# EasyEDA Pro project SuperCapTestBoard - copy - 2 25.eprj (continued)
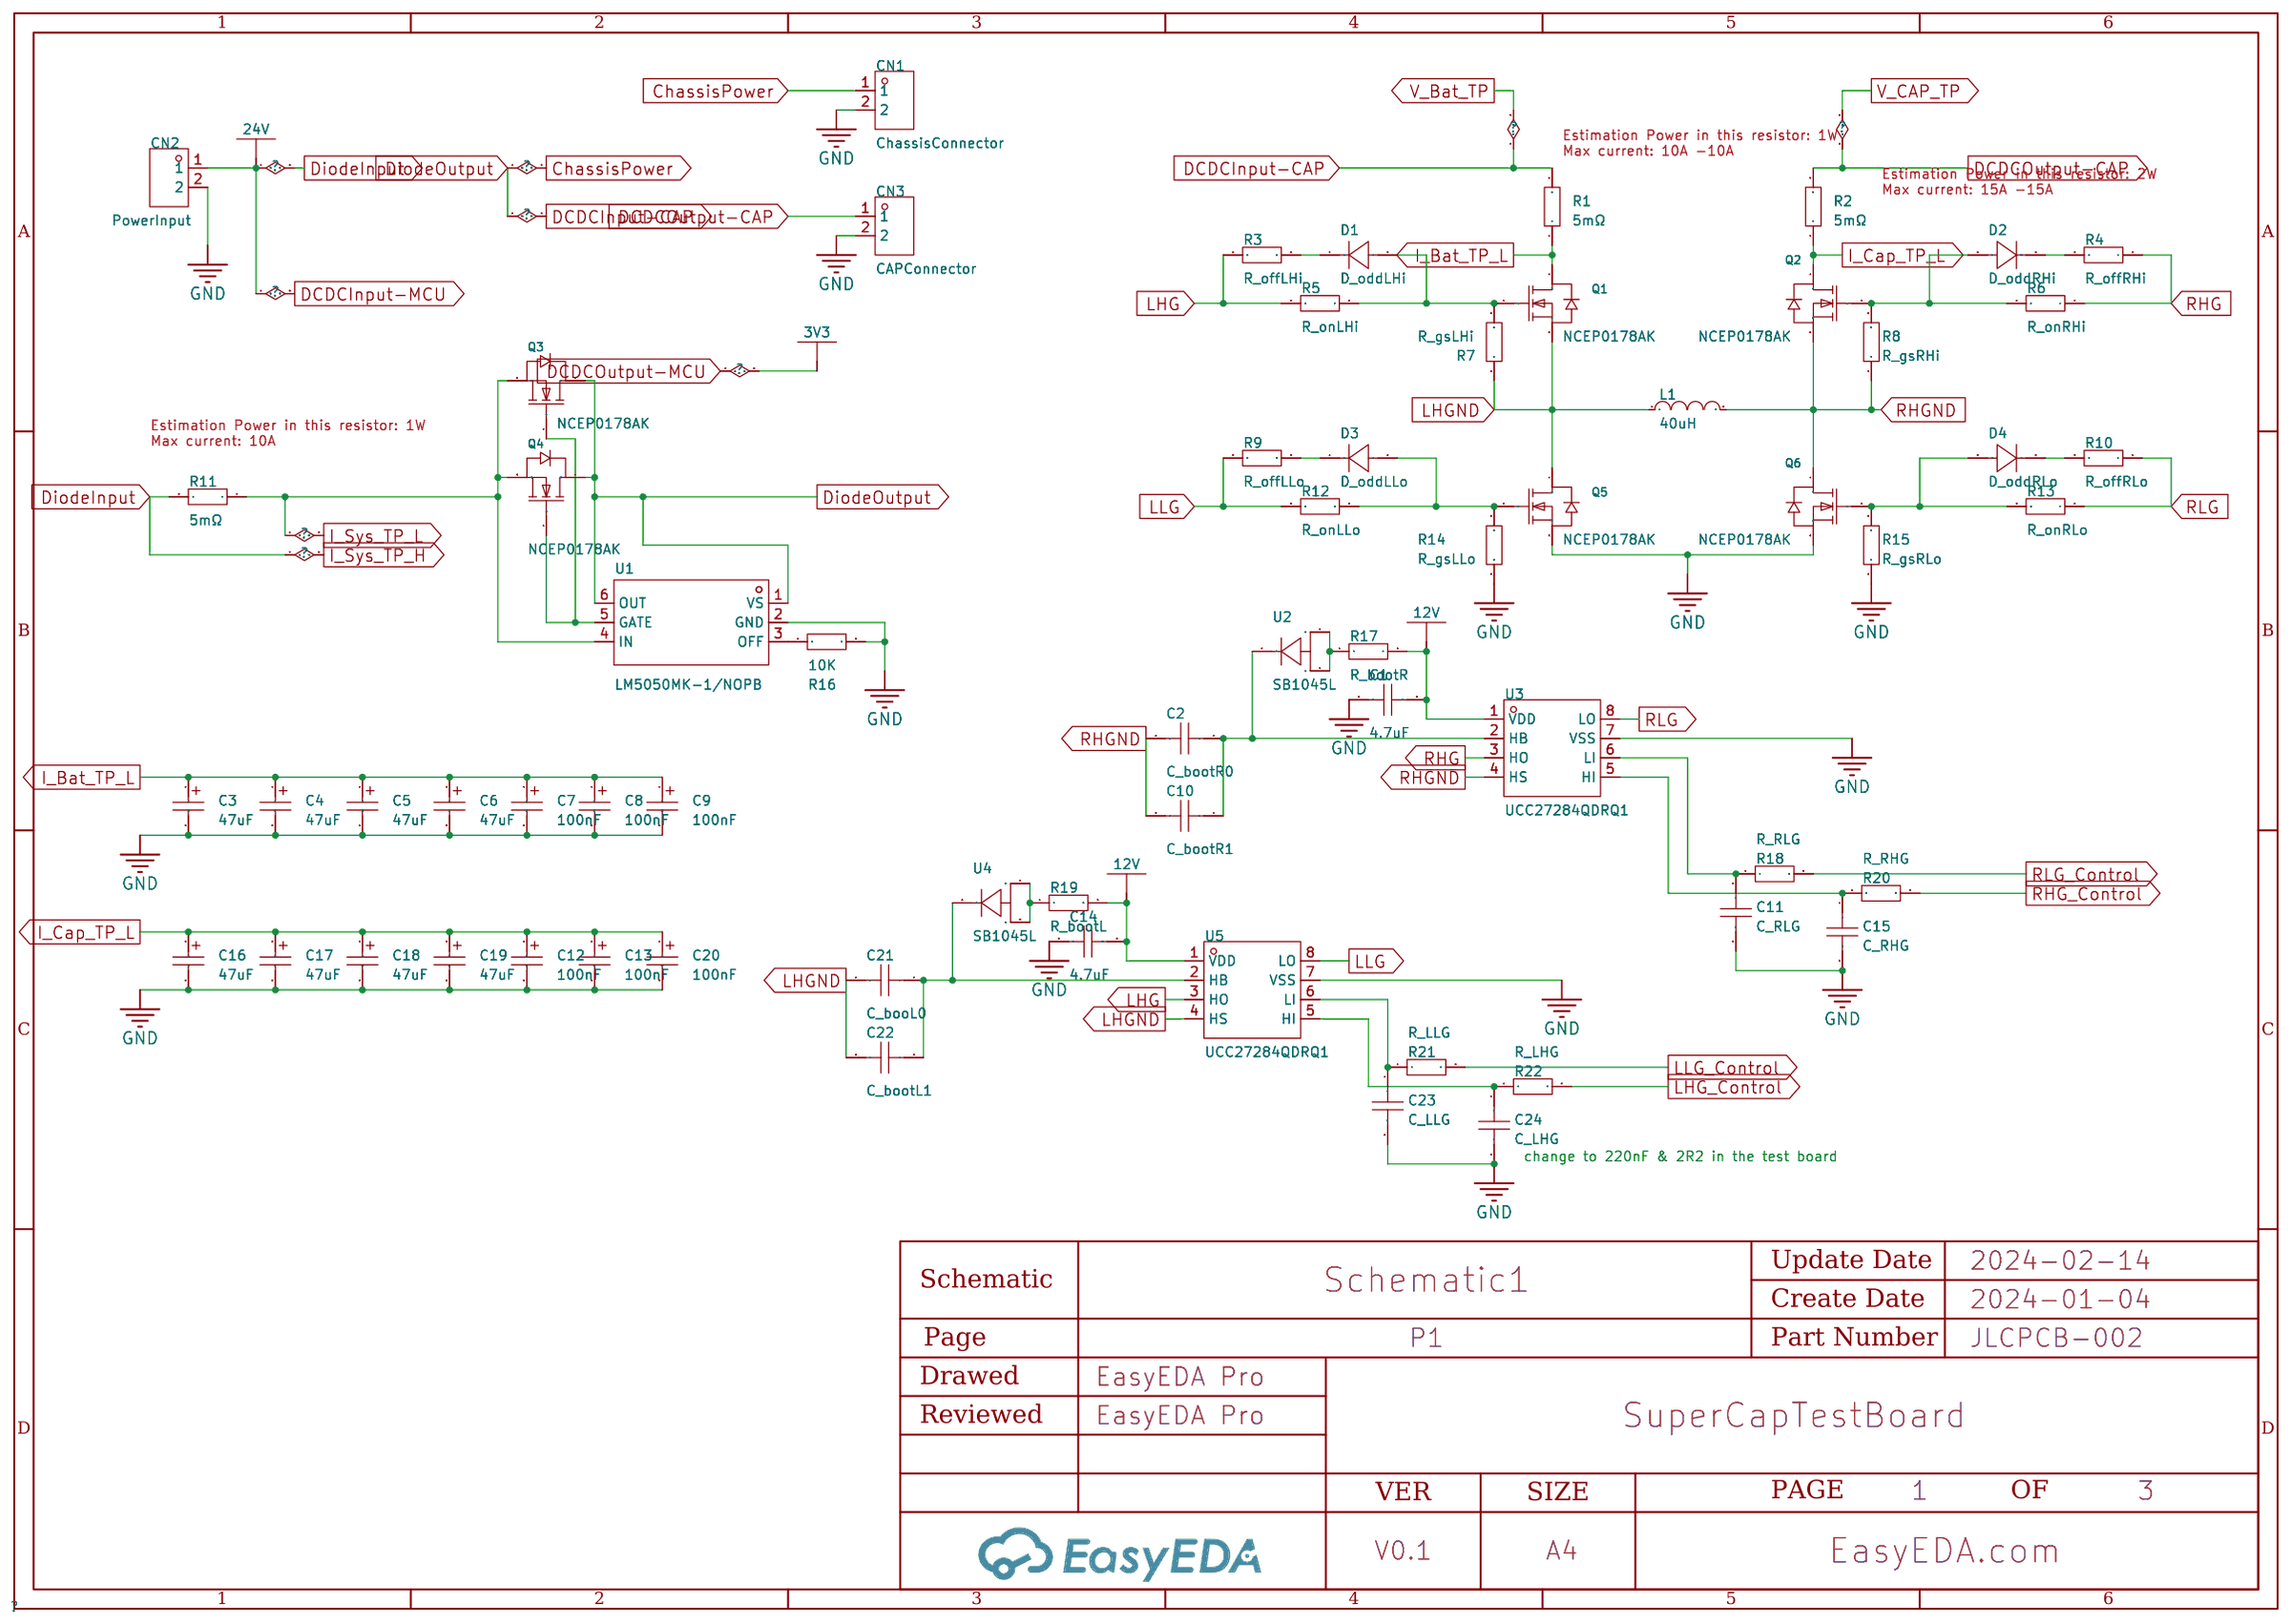
[diagram p0: P1]
## Placement (name value [footprint] x y rotation side) (continued)
L3  10uH  [L0805]  14.09 75.24 0 top
Q1  NCEP0178AK  [TO-252-2_L6.5-W6.1-P4.58-LS10.0-TL]  41.66 25.07 90 top
Q2  NCEP0178AK  [TO-252-2_L6.5-W6.1-P4.58-LS10.0-TL]  73.22 39.45 0 top
Q3  NCEP0178AK  [TO-252-2_L6.5-W6.1-P4.58-LS10.0-TL]  41.78 40.95 180 top
Q4  NCEP0178AK  [TO-252-2_L6.5-W6.1-P4.58-LS10.0-TL]  28.19 40.95 180 top
Q5  NCEP0178AK  [TO-252-2_L6.5-W6.1-P4.58-LS10.0-TL]  37.53 11.07 90 top
Q6  NCEP0178AK  [TO-252-2_L6.5-W6.1-P4.58-LS10.0-TL]  60.01 39.58 0 top
R1  5mΩ  [R2512]  50.29 35.36 90 top
R2  5mΩ  [R2512]  76.71 48.31 90 top
R3  2.2  [R0603]  20.19 17.32 0 top
R4  2.2  [R0603]  73.28 64.95 180 top
R5  2.2  [R0603]  23.24 13.89 0 top
R6  2.2  [R0603]  71.25 62.66 180 top
R7  10K  [R0603]  32 18.59 270 top
R8  10K  [R0603]  66.04 62.66 0 top
R9  2.2  [R0603]  20.19 10.97 0 top
R10  2.2  [R0603]  74.29 59.61 180 top
R11  5mΩ  [R2512]  36.19 58.85 90 top
R12  2.2  [R0603]  23.24 7.8 0 top
R13  2.2  [R0603]  72.01 56.82 180 top
R14  10K  [R0603]  32 6.78 90 top
R15  10K  [R0603]  61.85 44.88 270 top
R16  10K  [R0603]  18.29 38.28 180 top
R17  2.2  [R0805_NEW]  75.95 67.74 0 top
R18  10  [R0603]  85.98 62.66 0 top
R19  2.2  [R0805_NEW]  12.7 18.97 180 top
R20  10  [R0603]  82.68 58.47 270 top
R21  10  [R0603]  16.42 9.38 270 top
R22  10  [R0603]  16.36 6.11 270 top
R23  510K  [R0603]  3.3 50.47 0 top
R24  900k  [R0603]  17.14 48.31 0 top
R25  510K  [R0603]  7.11 49.71 180 top
R26  100k  [R0603]  13.84 48.31 0 top
R27  10k  [R0603]  63.63 76.38 90 top
R28  10k  [R0603]  63.88 72.7 90 top
R29  20k  [R0603]  47.82 46.34 270 top
R30  20k  [R0603]  89.64 49.3 180 top
R31  2k  [R0603]  47.82 49.52 270 top
R32  2k  [R0603]  92.94 49.3 180 top
U1  LM5050MK-1/NOPB  [TSOT-23-6_L2.9-W1.6-P0.95-LS2.8-BR]  18.16 41.96 270 top
U2  SB1045L  [TO-277_3P-L5.4-W4.0-LS6.5-TR]  76.71 72.19 0 top
U3  UCC27284QDRQ1  [SOIC-8_L4.9-W3.9-P1.27-LS6.0-BL]  79.88 63.3 270 top
U4  SB1045L  [TO-277_3P-L5.4-W4.0-LS6.5-TR]  15.73 22.42 180 top
U5  UCC27284QDRQ1  [SOIC-8_L4.9-W3.9-P1.27-LS6.0-BL]  14.48 14.4 270 top
U6  SY8501FCC  [SO-8_L4.9-W3.9-P1.27-LS6.0-BL-EP]  12.7 52.76 270 top
U7  LM1117DTX-3.3/NOPB  [TO-252-2_L6.6-W6.1-P4.57-LS9.9-BR-CW]  6.35 69.27 270 top
U8  INA181A1IDBVT  [SOT-23-6_L2.9-W1.6-P0.95-LS2.8-BL]  48.01 66.09 90 top
U9  INA181A1IDBVT  [SOT-23-6_L2.9-W1.6-P0.95-LS2.8-BL]  82.55 46.53 90 top
U10  INA181A1IDBVT  [SOT-23-6_L2.9-W1.6-P0.95-LS2.8-BL]  55.5 45.39 90 top
U11  TLV521DCKR  [SC-70-5_L2.1-W1.3-P0.65-LS2.1-BR]  61.34 74.6 270 top

## Footprints (pads in the part's own frame, mm; a bottom-side part is the same pattern mirrored in y, then rotated)
C0603
  rect 0.8x0.9 smd: 1(-0.7,0) 2(0.7,0)
CAP-SMD_BD6.3-L6.6-W6.6-LS7.2-FD-1
  rect 3.5x1.2 smd: 1(-2.67,0) 2(2.67,0)
CAP-SMD_L3.2-W1.6-RD-C7171
  rect 1.758x1.296 smd: 1(-1.687,0) 2(1.687,0)
CONN-TH_XT30U-M
  round 3.8 hole 2.54: 1(-2.5,0) 2(2.5,0)
DO-214AC_L4.3-W2.4-LS4.7-RD
  rect 2x2 smd: 1(-2.15,0) 2(2.15,0)
do-214ac_l4.3-w2.7-ls5.2-rd
  rect 2x2 smd: 1(-2.3,0) 2(2.3,0)
HDR-TH_2P-P2.54-V-F
  rect 1.7x1.7 hole 1: 1(-1.27,0)
  round 1.7 hole 1: 2(1.27,0)
ind-smd_l7.0-w6.6_cmkd-0630a
  rect 2.6x3.5 smd: 1(-3.035,0) 2(3.035,0)
Inductor 080125
  round 2.5 hole 1.4: 1(0,-4) 2(0,-14)
L0805
  rect 1.133x1.377 smd: 1(-0.966,0) 2(0.966,0)
R0603
  rect 0.806x0.864 smd: 1(-0.753,0) 2(0.753,0)
R0805_NEW
  rect 1.133x1.377 smd: 1(-0.966,0) 2(0.966,0)
R2512
  rect 1.282x3.456 smd: 1(-3.067,0) 2(3.067,0)
SC-70-5_L2.1-W1.3-P0.65-LS2.1-BR
  rect 0.9x0.4 smd: 1(1.1,-0.65) 2(1.1,0) 3(1.1,0.65) 4(-1.1,0.65) 5(-1.1,-0.65)
SO-8_L4.9-W3.9-P1.27-LS6.0-BL-EP
  oval 0.6x1.6 smd: 1(-1.905,-3) 2(-0.635,-3) 3(0.635,-3) 4(1.905,-3) 5(1.905,3) 6(0.635,3) 7(-0.635,3) 8(-1.905,3)
  rect 3.2x2.5 smd: 9(0,0)
SOIC-8_L4.9-W3.9-P1.27-LS6.0-BL
  oval 0.588x2.045 smd: 1(-1.905,-2.772) 2(-0.635,-2.772) 3(0.635,-2.772) 4(1.905,-2.772) 5(1.905,2.772) 6(0.635,2.772) 7(-0.635,2.772) 8(-1.905,2.772)
SOT-23-6_L2.9-W1.6-P0.95-LS2.8-BL
  rect 0.532x1.072 smd: 1(-0.95,-1.149) 2(0,-1.149) 3(0.95,-1.149) 4(0.95,1.149) 5(0,1.149) 6(-0.95,1.149)
TO-252-2_L6.5-W6.1-P4.58-LS10.0-TL
  rect 2.8x1.35 smd: 1(-3.475,2.29)
  rect 2.8x1.5 smd: 3(-3.475,-2.29)
  rect 6.5x6 smd: 4(3.475,-0.017)
TO-252-2_L6.6-W6.1-P4.57-LS9.9-BR-CW
  rect 3x1.6 smd: 1(3.424,-2.29) 3(3.424,2.29)
  rect 6.2x5.8 smd: 2(-3.424,0)
TO-277_3P-L5.4-W4.0-LS6.5-TR
  rect 1.29x1.423 smd: 1(2.054,0.92) 3(2.054,-0.92)
  rect 5.2x3.8 smd: 2(-2.054,0)
TSOT-23-6_L2.9-W1.6-P0.95-LS2.8-BR
  rect 0.8x0.532 smd: 1(1.2,-0.95) 2(1.2,0) 3(1.2,0.95) 4(-1.2,0.95) 5(-1.2,0) 6(-1.2,-0.95)

## Nets
As in the schematic, except:
CHASSISPOWER: CN1.1 Q3.4 Q4.4 R1.2 R29.2 U1.1 U1.6 U10.3
DCDCOUTPUT-CAP: CN3.1 R2.2 R30.2 U9.3
I_BAT_TP_L: C3.1 C4.1 C5.1 C6.1 C7.1 C8.1 C9.1 Q1.4 R1.1 U10.4
I_CAP_TP_L: C12.1 C13.1 C16.1 C17.1 C18.1 C19.1 C20.1 Q2.4 R2.1 U9.4
I_SYS_TP_L: Q3.3 Q4.3 R11.1 U1.4 U8.4
LHG_CONTROL: H7.1 R22.2
LLG_CONTROL: H7.2 R21.2
RHG_CONTROL: H6.1 R20.2
RLG_CONTROL: H6.2 R18.2

Pads without a net: U6 1

## Via types
v1: diameter 0.61, hole 0.305, Top Layer to Bottom Layer, 460 vias

## Routing (per net, layer and track width the routed paths; a pad name or vN(x,y) marks a point on that pad's centre or on a via; arc(x,y) is an arc through that point)
1V65: length 128.4
  Top Layer w0.254: U11.4 62.67,76.38 83.19,76.38 94.87,64.69 94.87,60.38 89.66,55.17 89.66,46.15 88.26,44.76 80.9,44.76 80.39,45.26 80.39,46.28 80.65,46.53 U9.5 ; 48.58,63.81 48.01,64.38 48.01,65.33 47.24,66.09 U8.5 ; 48.58,63.81 47.12,63.81 45.47,62.15 45.47,55.04 48.26,52.25 51.69,52.25 53.96,49.98 ; 48.58,63.81 49.1,63.81 ; 53.96,49.98 v1(55.25,48.69) ; 53.96,49.98 53.97,49.99 C41.1 ; U11.1 51,63.81 49.1,63.81 ; U10.5 54.99,45.39 55.25,45.64 v1(55.25,47.42) ; C42.1 49.91,63 49.1,63.81
  Top Layer w0.508: 59.46,74.73 U11.1 ; 59.46,74.73 61.02,74.73 U11.4 ; 59.46,74.73 58.36,74.73 ; C43.1 81.41,44.73
  Bottom Layer w0.254: v1(55.25,48.69) v1(55.25,47.42)
3V3: length 12.5
  Top Layer w1.016: C35.1 6.31,72.73 U7.2 10.57,72.69 13.12,75.24
12V: length 168.5
  Top Layer w0.508: R24.2 17.9,46.46 17.84,46.41 ; 18.11,46.41 11.73,40.03 11.73,37.21 2.79,28.27 2.79,19.23 3.05,18.97 R19.2
  Top Layer w0.762: U3.1 77.09,65.22 77.09,67.67 79.26,67.67 C14.2 ; L2.2 21.34,59.12 C30.2 C31.2 C32.2 27.23,54.99 27.94,54.28 27.94,51.49 26.43,49.98 D5.2 25.05,49.96 23.4,48.31 R24.2 ; C1.2 U5.1 11.71,18.95 R19.2 ; 11.65,65.84 11.68,65.81 v1(11.68,65.46) C34.1
  Top Layer w1.016: U7.3 11.65,65.84 11.68,65.87
  Bottom Layer w0.762: v1(21.21,60.88) 15.88,66.22 ; 15.88,66.22 26.03,76.38 73.91,76.38 76.96,73.33 v1(76.96,67.74) ; 15.88,66.22 v1(11.68,66.22)
  vias: v1(21.21,60.04) v1(21.21,59.19) v1(21.21,58.34) v1(22.1,60.88) v1(22.1,60.04) v1(22.1,59.19) v1(22.1,58.34)
24V: length 67.1
  Top Layer w0.254: v1(44.58,70.16) 46.74,68 48.01,68 48.96,67.04 U8.3
  Top Layer w0.762: R11.2 35.45,62.66 14.86,62.66 13.08,60.88 13.08,59.85 7.81,54.58 ; R25.2 5.59,49.71 4.95,49.07 3.13,49.07 2.55,49.66 R23.1 2.54,50.48 2.54,52.25 2.79,52.5 C26.2 C27.2 C28.2 7.81,54.58 ; 7.81,54.58 8.01,54.58 9.2,53.39 U6.2
  Top Layer w1.27: CN2.1 32.7,63.91 32.7,62.66
  Bottom Layer w0.762: v1(44.58,70.16) v1(39.37,70.16)
GND: length 55.4
  Top Layer w1.27: 97.28,22.66 97.28,18.97 C12.2 C20.2
  Bottom Layer w0.762: 59.31,49.33 v1(61.85,46.79)
  Bottom Layer w1.27: v1(84.2,29.9) 92.07,29.9 v1(92.2,29.77) ; v1(84.2,29.9) v1(84.2,28.63) ; v1(84.2,29.9) 81.06,33.04 76.45,33.04 ; v1(30.86,23.8) v1(29.84,23.8) 27.09,23.8 v1(24.64,26.25) v1(24.64,27.27) ; v1(92.2,29.77) 96.01,29.77 ; v1(92.2,29.77) v1(92.2,28.5) ; 76.45,33.04 v1(76.45,32.44) ; 76.45,33.04 v1(76.45,33.71)
  vias: v1(0.89,77.27) v1(0.89,76) v1(1.02,4.75) v1(1.02,3.48) v1(1.02,2.21) v1(1.02,0.94) v1(1.65,71.04) v1(2.16,77.27) v1(2.29,3.48) v1(2.29,2.21) v1(2.29,0.94) v1(2.54,65.84) v1(3.56,60.52) v1(3.56,45.28) v1(3.56,40.2) v1(3.56,35.12) v1(3.56,30.04) v1(3.56,24.96) v1(3.56,19.88) v1(3.56,14.8) v1(3.56,9.72) v1(3.56,4.64) v1(3.56,2.21) v1(3.56,0.94) v1(3.99,56.52) v1(4.45,52.12) v1(4.83,0.94) v1(5.72,65.84) v1(5.65,53.3) v1(6.41,56.54) v1(7.24,27.23) v1(7.24,26.21) v1(7.75,15.04) v1(8.64,60.52) v1(8.64,45.28) v1(8.64,40.2) v1(8.64,35.12) v1(8.64,30.04) v1(8.64,24.96) v1(8.64,19.88) v1(8.64,14.8) v1(8.64,4.64) v1(11.68,62.66) v1(12.32,35.02) v1(12.32,34) v1(12.57,8.69) v1(12.7,55.42) v1(12.7,52.76) v1(13.72,70.68) v1(13.72,58.98) v1(13.72,55.44) v1(13.72,50.36) v1(13.72,45.28) v1(13.72,40.2) v1(13.72,24.96) v1(16.51,63.81) v1(16.99,50.02) v1(17.53,39.42) v1(17.53,37.14) v1(17.91,60.88) v1(18.8,70.68) v1(18.8,60.52) v1(18.8,9.72) v1(18.8,4.64) v1(18.97,73.98) v1(19.3,16.05) v1(19.43,60.88) v1(20.7,35.02) v1(20.7,34) v1(21.34,51.85) v1(22.49,53.03) v1(23.24,75.36) v1(23.75,51.85) v1(23.88,50.36) v1(23.88,4.64) v1(24.96,53.06) v1(26.16,51.86) v1(27.05,8.94) v1(28.19,35.02) v1(28.19,34) v1(28.96,14.8) v1(28.96,4.64) v1(31.75,15.8) v1(33.25,5.98) v1(34.03,9.72) v1(34.03,4.64) v1(35.56,35.02) v1(35.56,34) v1(38.52,8.22) v1(38.52,6.95) v1(39.12,9.72) v1(39.12,4.64) v1(41.12,8.24) v1(41.12,6.97) v1(41.87,73.35) v1(43.56,75.23) v1(43.56,73.97) v1(44.19,35.12) v1(44.19,14.8) v1(44.19,9.72) v1(44.19,4.64) v1(44.45,72.95) v1(44.83,53.26) v1(45.47,68) v1(45.47,36.88) v1(45.47,35.61) v1(46.61,11.99) v1(46.61,0.81) v1(46.74,36.88) v1(46.74,35.61) v1(46.74,15.55) v1(47.12,51.36) v1(47.88,11.99) v1(47.88,10.72) v1(47.88,2.08) v1(47.88,0.81) v1(48.01,16.81) v1(48.01,15.55) v1(48.1,66.12) v1(48.37,68.89) v1(49.28,70.68) v1(49.28,55.44) v1(49.78,24.31) v1(53.85,24.69) v1(53.85,23.42) v1(54.35,70.68) v1(54.35,65.6) v1(54.35,60.52) v1(54.35,55.44) v1(54.35,40.2) v1(55.12,24.69) v1(55.75,74.73) v1(55.88,38.53) v1(55.9,35.93) v1(55.88,34.59) v1(55.88,33.33) v1(56.13,54.15) v1(56.39,45.39) v1(57.15,38.53) v1(57.17,35.93) v1(57.15,34.59) v1(57.15,33.33) v1(57.4,47.3) v1(57.78,77.39) v1(59.06,77.39) v1(59.06,42.34) v1(59.06,41.07) v1(59.44,70.68) v1(59.44,65.6) v1(59.44,60.52) v1(59.44,55.44) v1(59.44,40.2) v1(59.44,35.12) v1(59.44,30.04) v1(60.32,77.39) v1(61.21,23.42) v1(61.34,72.36) v1(62.49,74.6) v1(62.48,24.69) v1(62.48,23.42) v1(64.51,70.68) v1(64.51,55.44) v1(64.51,50.36) v1(64.51,45.28) v1(64.51,24.96) v1(64.9,71.93) v1(65.02,77.39) v1(65.15,75.23) v1(66.29,77.39) v1(67.56,77.39) v1(69.59,30.04) v1(69.59,24.96) v1(69.85,40.31) v1(71.88,49.33) v1(72.26,43.1) v1(73.27,45.34) v1(74.68,55.44) v1(74.68,24.96) v1(78.49,66.34) v1(79.15,57.77) v1(79.75,60.52) v1(79.75,55.44) v1(81.15,63.93) v1(81.41,40.56) v1(81.5,55.93) v1(81.6,57.77) v1(81.91,67.62) v1(83.95,55.93) v1(83.97,59.57) v1(84.2,63.93) v1(84.2,39.68) v1(84.2,38.41) v1(84.71,46.53) v1(84.84,70.68) v1(84.84,65.6) v1(85.22,58.34) v1(86.29,55.93) v1(86.36,41.07) v1(89.91,75.76) v1(89.91,45.28) v1(92.16,39.81) v1(92.16,38.54) v1(95,75.76) v1(95,70.68) v1(95,55.44) v1(95,50.36) v1(95,45.28) v1(95,24.96) v1(95.12,77.01) v1(95.12,23.55) v1(96.39,77.01) v1(96.39,75.74) v1(96.39,24.82) v1(96.39,23.55) v1(97.66,77.01) v1(97.66,75.74) v1(97.66,74.47) v1(97.66,26.09) v1(97.66,24.82) v1(97.66,23.55) v1(98.93,77.01) v1(98.93,75.74) v1(98.93,74.47) v1(98.93,73.2) v1(98.93,27.36) v1(98.93,26.09) v1(98.93,24.82) v1(98.93,23.55)
ADC12_IN0: length 5.3
  Top Layer w0.254: H1.1 50.29,68.12 50.29,65.92 49.51,65.14 U8.1
ADC12_IN1: length 5.9
  Top Layer w0.254: U10.1 56.65,44.13 v1(56.01,43.48)
  Bottom Layer w0.254: v1(56.01,43.48) H3.1
ADC12_IN2: length 2.8
  Top Layer w0.254: 83.7,45.58 85.92,45.58 H4.1
ADC12_IN3: length 5.4
  Top Layer w1.27: 47.82,47.97 50.84,47.97 H5.1 ; 47.82,47.97 R31.2 ; 47.82,47.97 R29.1
ADC12_IN4: length 4.5
  Top Layer w0.762: R30.1 92.06,49.3
  Top Layer w1.27: R32.2 92.18,49.31 H8.1
CHASSISPOWER: length 47.3
  Top Layer w0.254: v1(52.2,39.81) 52.2,40.06 54.99,42.85 56.39,42.85 57.53,43.99 57.53,46.12 57.31,46.34 U10.3 ; 17.21,41.95 17.71,41.45 24.23,41.45 Q4.4 ; 17.21,41.95 U1.1 ; 17.21,41.95 17.21,43.16
  Top Layer w0.762: R1.2 47.75,40.96 Q3.4
  Top Layer w1.27: Q4.4 Q3.4
  vias: v1(22.81,42.87) v1(22.81,41.6) v1(24.08,42.87) v1(24.08,41.6) v1(25.35,42.87) v1(25.35,41.6) v1(26.62,42.87) v1(26.62,41.6) v1(36.4,42.87) v1(36.4,41.6) v1(36.4,40.33) v1(36.4,39.06) v1(37.67,42.87) v1(37.67,41.6) v1(37.67,40.33) v1(37.67,39.06) v1(38.94,42.87) v1(38.94,41.6) v1(38.94,40.33) v1(38.94,39.06) v1(40.21,42.87) v1(40.21,41.6) v1(40.21,40.33) v1(40.21,39.06) v1(48.39,39.81) v1(48.39,37.3) v1(49.66,39.81) v1(49.66,37.3) v1(50.93,39.81) v1(50.93,37.3) v1(52.2,37.3)
DCDCOUTPUT-CAP: length 1.3
  Top Layer w0.254: U9.3 83.7,48.82
  vias: v1(73.91,52.76) v1(74.8,49.31) v1(75.18,54.03) v1(75.18,52.76) v1(76.07,49.31) v1(76.45,54.03) v1(76.45,52.76) v1(77.34,49.31) v1(78.61,49.31) v1(89.92,66.85) v1(91.19,66.85)
I_BAT_TP_L: length 73.7
  Top Layer w0.254: v1(53.47,42.72) 53.47,46.12 53.69,46.34 U10.4 ; R1.1 51.54,32.29 53.47,34.21 v1(53.47,38.91)
  Top Layer w1.27: C6.1 35.69,29 C5.1 ; C3.1 26.96,23.71 26.96,26.75 28.19,27.98 v1(28.19,28.62) C4.1 ; C9.1 12.32,26.34 v1(12.32,28.62) C7.1 C8.1
  Bottom Layer w0.254: v1(53.47,42.72) v1(53.47,38.91)
  Bottom Layer w1.27: 12.32,29.16 v1(12.32,28.62) 12.32,26.16 7.24,21.08 ; 12.32,29.16 v1(12.32,29.64) ; 12.32,29.16 12.37,29.11 20.7,29.11 ; 35.81,25.58 35.74,25.5 35.74,23.8 ; 20.7,29.11 v1(20.7,28.59) ; 20.7,29.11 v1(20.7,29.6) ; 35.74,23.8 v1(36.23,23.8) ; 35.74,23.8 v1(35.22,23.8) ; v1(7.24,21.63) 7.24,21.08 ; 7.24,21.08 v1(7.24,20.61)
  vias: v1(28.19,29.64) v1(35.56,29.7) v1(35.56,28.69) v1(39.77,30.45) v1(39.77,29.18) v1(39.77,27.91) v1(39.77,26.64) v1(41.04,30.45) v1(41.04,29.18) v1(41.04,27.91) v1(41.04,26.64) v1(42.31,30.45) v1(42.31,29.18) v1(42.31,27.91) v1(42.31,26.64) v1(43.58,30.45) v1(43.58,29.18) v1(43.58,27.91) v1(43.58,26.64)
I_CAP_TP_L: length 43.2
  Top Layer w0.254: v1(78.61,46.71) 79.39,47.48 U9.4
  Top Layer w0.508: v1(77.33,40.07) Q2.4
  Top Layer w1.27: C16.1 80.39,23.8 C17.1 ; C18.1 92.03,33.7 C13.1 ; C20.1 C12.1
  Top Layer w2.032: Q2.4 76.69,45.23 R2.1
  vias: v1(74.8,46.71) v1(74.79,41.34) v1(74.79,40.07) v1(74.79,38.8) v1(74.79,37.53) v1(76.07,46.71) v1(76.06,41.34) v1(76.06,40.07) v1(76.06,38.8) v1(76.06,37.53) v1(76.45,28.37) v1(76.45,27.1) v1(77.34,46.71) v1(77.33,41.34) v1(77.33,38.8) v1(77.33,37.53) v1(77.98,34.59) v1(77.98,31.55) v1(78.6,41.34) v1(78.6,40.07) v1(78.6,38.8) v1(78.6,37.53) v1(79.25,34.59) v1(79.25,31.55) v1(81.79,34.34) v1(81.79,30.4) v1(81.79,29.13) v1(83.06,34.34) v1(83.06,33.07) v1(83.06,29.13) v1(84.2,34.34) v1(84.2,33.07) v1(84.2,24.52) v1(84.2,23.25) v1(84.2,19.87) v1(84.2,18.6) v1(85.72,31.42) v1(85.72,28.37) v1(87,31.42) v1(87,28.37) v1(89.41,31.42) v1(89.41,28.37) v1(90.68,31.42) v1(90.68,28.37) v1(92.16,34.34) v1(92.16,33.07) v1(92.2,24.43) v1(92.2,23.16) v1(92.2,19.87) v1(92.2,18.6) v1(93.99,31.35) v1(93.99,28.31)
I_SYS_TP_L: length 62.7
  Top Layer w0.254: v1(45.64,66.98) 46.8,66.98 U8.4
  Top Layer w0.762: 41.79,68.89 41.79,61.38 R11.1 ; 19.11,43.16 21.34,45.39 29.51,45.39
  Top Layer w1.27: 29.51,45.39 Q4.3 ; 29.51,45.39 43.1,45.39 Q3.3 ; 29.51,45.39 36.21,52.09 36.21,55.68
  Bottom Layer w0.254: v1(43.69,66.98) v1(45.64,66.98)
LHG: length 14.4
  Top Layer w0.254: U5.3 13.17,13.77 16.73,17.32 R3.1 20.58,16.18 21.46,16.18 22.49,15.16 R5.1
LHG_CONTROL: length 3.9
  Top Layer w0.508: H7.1 15.91,5.82 R22.2
LHGND: length 73.2
  Top Layer w0.254: C21.2 9.17,12.53 9.17,13.16 10.41,14.4 12.95,14.4 17.91,19.36 32,19.36 R7.1 ; C21.2 C22.2 ; C21.2 U5.4
  Top Layer w1.27: R7.1 32.75,19.35 v1(35.64,16.45) v1(36.91,15.18) Q5.4 v1(38.18,13.91) 38.45,13.64 57.98,13.64 L1.1
  Top Layer w2.032: Q1.3 43.95,20.95 v1(39.45,16.45) v1(38.18,15.18) Q5.4
  vias: v1(30.9,19.99) v1(30.9,18.72) v1(35.64,15.18) v1(35.64,13.91) v1(35.64,12.64) v1(36.91,16.45) v1(36.91,13.91) v1(36.91,12.64) v1(38.18,16.45) v1(38.18,12.64) v1(39.45,15.18) v1(39.45,13.91) v1(39.45,12.64) v1(42.42,23.04) v1(42.42,21.77) v1(57.4,14.78) v1(58.67,16.05) v1(58.67,14.78)
LLG: length 11.8
  Top Layer w0.254: U5.8 17.91,16.31 19.43,14.78 19.43,10.98 R9.1 20.46,9.96 21.72,9.96 22.49,9.19 R12.1
LLG_CONTROL: length 7.5
  Top Layer w0.508: H7.2 11.56,7.29 15.08,7.29 R21.2
REF3V3: length 127.6
  Top Layer w0.254: 44.83,66.05 44.83,54.53 49.78,49.58 52.45,49.58 53.97,48.06 55.48,48.06 ; 44.83,66.05 45.74,65.14 U8.6 ; 44.83,66.05 44.83,67.49 42.54,69.77 42.54,75.25 41.41,76.38 ; v1(67.94,48.06) 56.77,48.06 ; 56.77,48.06 55.48,48.06 ; 56.77,48.06 55.75,47.04 55.75,45.52 54.68,44.44 U10.6 ; 41.41,76.38 18.73,76.38 C36.1 ; 41.41,76.38 60.01,76.38 U11.5 ; v1(71.63,48.06) 82.17,48.06 82.42,47.8 82.42,46.03 81.98,45.58 81.4,45.58 ; 56.13,50.15 56.13,48.71 55.48,48.06
  Top Layer w0.508: R27.2 62.12,77.13 U11.5
  Top Layer w0.762: C39.1 72.59,47.18 72.59,48.06
  Top Layer w1.27: C36.1 17.58,75.24 L3.2
  Bottom Layer w0.254: v1(67.94,48.06) v1(71.63,48.06)
RHG: length 8.2
  Top Layer w0.508: R4.1 74.03,64.69 R6.1 U3.3
RHG_CONTROL: length 3.2
  Top Layer w0.381: R20.2 H6.1
RHGND: length 64.4
  Top Layer w0.508: v1(61.59,61.39) v1(62.87,61.39) v1(64.13,61.39) v1(65.41,61.39) 66.5,61.39 ; 66.5,61.39 U3.4 ; 66.5,61.39 65.29,62.61 R8.1 64.52,63.43 64.52,66.85 66.99,69.33 C10.2
  Top Layer w0.762: C10.2 C2.2
  Top Layer w2.032: L1.2 63.48,29.15 Q6.4 67.34,39.56 Q2.3
  vias: v1(52.45,20.24) v1(52.45,18.97) v1(52.45,17.7) v1(52.45,16.43) v1(53.72,20.24) v1(53.72,18.97) v1(53.72,17.7) v1(54.99,20.24) v1(54.99,18.97) v1(56.26,20.24) v1(61.59,41.45) v1(61.59,40.18) v1(61.59,38.91) v1(61.59,37.64) v1(62.87,41.45) v1(62.87,40.18) v1(62.87,38.91) v1(62.87,37.64) v1(64.13,41.45) v1(64.13,40.18) v1(64.13,38.91) v1(64.13,37.64) v1(65.41,41.45) v1(65.41,40.18) v1(65.41,38.91) v1(65.41,37.64) v1(65.53,35.74) v1(65.53,34.47) v1(65.53,33.2) v1(65.53,31.93) v1(66.68,35.74) v1(66.68,34.47) v1(66.68,33.2) v1(66.68,31.93) v1(67.94,35.74) v1(67.94,34.47) v1(67.94,33.2) v1(69.22,35.74) v1(69.22,34.47) v1(70.49,35.74)
RLG: length 15.1
  Top Layer w0.254: U3.8 80.14,65.2 78.87,63.93 78.87,61.41 77.07,59.61 R10.1 72.76,57.33 R13.1
RLG_CONTROL: length 8.8
  Top Layer w0.381: R18.2 86.73,57.83 85.22,56.31 H6.2
$1N1327: length 2.5
  Top Layer w0.254: R16.1 19.11,38.35 U1.3
$1N6258: length 3.1
  Top Layer w0.254: D1.1 R3.2
$1N6388: length 23.4
  Top Layer w0.254: D1.2 27.42,17.32 R5.2
  Top Layer w0.508: v1(29.21,19.99) 30.23,21.01 38.78,21.01 Q1.1 ; v1(29.21,18.72) 29.21,18.07 29.95,17.32
  Top Layer w0.762: R7.2 31.49,17.32 D1.2
  Bottom Layer w0.508: v1(29.21,18.72) v1(29.21,19.99)
$1N6557: length 3.1
  Top Layer w0.254: D3.1 R9.2
$1N6577: length 15.6
  Top Layer w0.254: R12.2 27.17,10.97 D3.2 28.32,10.96 28.32,8.31 29.09,7.54 R14.2
  Top Layer w1.27: R14.2 35.18,7.54 Q5.1
$1N6908: length 2.4
  Top Layer w0.508: 70.35,65.58 71.89,65.58 R4.2
$1N6911: length 2.4
  Top Layer w0.254: R10.2 D4.1
$1N6922: length 30.6
  Top Layer w0.254: v1(69.6,62.66) 67.82,64.44 v1(67.82,65.46) ; 66.79,65.46 R8.2
  Top Layer w0.762: v1(70.49,55.55) 70.49,42.48 Q2.1 ; v1(69.6,62.66) R6.2 ; v1(67.82,65.46) 66.18,65.46 D2.2
  Bottom Layer w0.762: v1(69.6,62.66) 70.49,61.77 v1(70.49,55.55)
$1N6941: length 31.9
  Top Layer w0.762: 68.39,58.03 68.39,56.12 69.16,55.36 69.16,46.6 66.17,43.61 58.28,43.61 Q6.1 ; 68.39,58.03 D4.2 ; 68.39,58.03 69.6,56.82 R13.2
$1N7206: length 4.3
  Top Layer w0.254: C11.1 85.23,60.96 R18.1 U3.6
$1N7273: length 4.5
  Top Layer w0.254: U3.5 82.66,59.25 R20.1 80.44,59.22 C15.1
$1N7440: length 8.2
  Top Layer w0.254: U5.6 16.26,13.77 15.37,12.88 15.37,11.58 C23.1 16.37,10.09 R21.1
$1N7452: length 7.9
  Top Layer w0.254: R22.1 17.25,7.75 ; 17.25,7.75 U5.5 ; 17.25,7.75 19.07,7.75 C24.1
$1N7629: length 30.5
  Top Layer w0.508: 18.16,43.16 18.16,42.63 18.71,42.09 v1(20.83,42.09) ; v1(29.21,38.66) 31.66,38.66 Q4.1 33.19,37.14 43.74,37.14 Q3.1
  Bottom Layer w0.508: v1(29.21,38.66) 24.26,38.66 v1(20.83,42.09)
$1N10834: length 17.4
  Top Layer w0.508: 73.2,70.73 72.9,70.43 72.9,66.98 73.53,66.34 74.93,66.34 75.44,65.84 75.44,64.33 75.83,63.93 U3.2
  Top Layer w0.762: C10.1 C2.1 73.2,70.73 U2.2
$1N10869: length 18.3
  Top Layer w0.254: U5.2 10.35,15.04 C21.1 C22.1
  Top Layer w0.508: U4.2 17.78,19.99 12.83,15.04 U5.2
$1N10964: length 4.4
  Top Layer w0.762: U4.3 U4.1 13.67,21.5 R19.1
$1N11017: length 8.3
  Top Layer w0.762: U2.1 U2.3 78.76,70.19 78.09,69.52 75.69,69.52 74.98,68.81 R17.1
$2N706: length 2.5
  Top Layer w0.762: C25.1 18.1,53.39 U6.7
$2N707: length 7.6
  Top Layer w0.762: 8.26,52.12 8.26,52 7.37,51.11 5.72,51.11 5.08,50.47 R23.2 ; 8.26,52.12 U6.3 ; 8.26,52.12 C29.2
$2N709: length 7
  Top Layer w0.762: D5.1 20.69,51.11 18.48,51.11 C33.1 17.46,52.12 U6.6
$2N715: length 2.3
  Top Layer w0.762: U6.4 9.01,50.85 R25.1
$2N718: length 7.3
  Top Layer w0.762: L2.1 15.7,59.42 U6.8 18.1,54.66 C25.2
$2N719: length 6.5
  Top Layer w0.508: 15.14,48.31 15.7,48.87 U6.5 ; 15.14,48.31 R26.2 ; 15.14,48.31 R24.1 16.44,48.26 16.44,46.41
$3N6491: length 6.2
  Top Layer w0.508: C40.1 65.86,73.45 R28.2 63.83,73.5 ; R27.1 63.63,74.6 63.83,74.4 63.83,73.5 ; 63.83,73.5 U11.3

## Copper pours and planes (outline as drawn; the poured copper is in the pictures)
12V on Bottom Layer: 20.45,61.27 22.99,61.27 22.99,57.71 20.45,57.71
12V on Bottom Layer: 11.05,66.73 12.32,66.73 12.32,64.95 11.05,64.95
24V on Top Layer: 26.42,75.62 17.02,66.22 23.5,59.74 23.5,56.19 30.61,56.19 33.27,58.85 37.85,58.85 40.64,61.65 40.64,72.95 41.91,74.22 41.91,74.98 41.28,75.62
GND on Top Layer: -1.33,-10.6 -1.33,32.45 -1.53,32.45 -1.53,80.59 102.87,80.59 102.87,21.79 48.58,21.79 48.58,-10.6
GND on Bottom Layer: -1.38,-4.97 -1.38,32.24 -1.57,32.24 -1.57,80.38 107.78,80.38 107.78,21.58 48.54,21.58 48.54,-4.97
CHASSISPOWER on Top Layer: 47.75,38.19 47.28,38.66 21.84,38.66 21.84,43.48 35.58,43.48 43.77,51.67 45.91,51.67 46.74,50.85 46.74,46.76 47.16,46.34 48.71,46.34 52.96,42.09 52.96,35.23 48.9,35.23 47.75,36.37
CHASSISPOWER on Bottom Layer: 52.9,42.12 52.9,35.26 47.69,35.26 47.69,38.22 47.22,38.69 21.78,38.69 21.78,43.52 35.52,43.52 43.7,51.71 45.85,51.71 46.67,50.88 46.67,46.8 47.09,46.38 48.64,46.38
DCDCOUTPUT-CAP on Top Layer: 73.28,48.53 73.28,52.88 74.93,54.54 86.19,54.54 89.28,57.63 89.28,67.49 92.07,67.49 94.87,64.69 94.87,60.38 89.46,54.97 89.46,48.88 89.12,48.53
DCDCOUTPUT-CAP on Bottom Layer: 73.28,48.59 73.28,52.94 74.93,54.59 86.19,54.59 89.28,57.68 89.28,67.54 92.07,67.54 94.87,64.75 94.87,60.43 89.46,55.03 89.46,52.74 85.31,48.59
I_BAT_TP_L on Top Layer: 47.75,34.98 53.72,34.98 53.72,29.39 49.02,24.69 22.61,24.69 21.59,25.71 21.59,28.63 19.81,30.4 18.02,30.4 17.4,31.02 17.4,32.31 17.78,32.69 45.47,32.69
I_BAT_TP_L on Bottom Layer: 47.75,34.85 53.72,34.85 53.72,29.26 49.02,24.56 22.61,24.56 21.59,25.58 21.59,28.5 19.81,30.28 18.02,30.28 17.4,30.89 17.4,32.18 17.78,32.56 45.47,32.56
I_CAP_TP_L on Top Layer: 73.43,47.3 73.43,28.47 80.76,21.14 80.76,17.33 92.7,17.33 94.74,19.37 94.74,35.74 80.14,35.74 79.98,35.89 79.98,47.3
I_CAP_TP_L on Bottom Layer: 73.55,47.36 73.55,28.53 80.88,21.2 80.88,17.39 92.82,17.39 94.85,19.43 94.85,35.8 80.26,35.8 80.1,35.95 80.1,47.36
I_SYS_TP_L on Top Layer: 33.27,58.34 38.23,58.34 41.4,61.52 41.4,69.01 41.53,68.89 42.42,68.89 44.2,67.11 44.2,52.88 34.55,43.23 31.67,43.23 29.51,45.39 24,45.39 28.7,50.09 28.7,55.55 30.48,55.55
LHGND on Top Layer: 41.67,24.31 41.67,20.52 39.37,18.21 35.31,18.21 33.15,20.37 30.46,20.37 30.07,19.98 30.07,19 34.17,14.9 34.17,11.34 41.23,11.34 42.73,12.85 59.79,12.85 62.23,15.29 62.23,17.58 61.47,18.34 60.2,18.34 56.64,14.78 41.91,14.78 41.53,15.16 41.53,16.56 45.59,20.62 45.59,23.29 44.58,24.31
LHGND on Bottom Layer: 41.75,24.31 41.75,20.52 39.45,18.22 35.38,18.22 33.23,20.38 30.54,20.38 30.15,19.98 30.15,19.01 34.25,14.91 34.25,11.35 41.31,11.35 42.81,12.85 59.87,12.85 62.31,15.3 62.31,17.58 61.55,18.34 60.28,18.34 56.72,14.79 41.99,14.79 41.61,15.17 41.61,16.57 45.67,20.63 45.67,23.3 44.66,24.31
RHGND on Top Layer: 60.2,42.6 60.2,36.5 62.36,34.34 62.36,30.66 49.28,17.58 49.28,15.55 49.66,15.16 51.82,15.16 64.9,28.25 64.9,29.26 71.12,35.48 71.12,37.9 66.55,42.47 60.32,42.47
RHGND on Bottom Layer: 61.09,61.77 65.91,61.77 65.91,37.14 61.09,37.14
RHGND on Bottom Layer: 60.2,42.6 60.2,36.5 62.36,34.34 62.36,30.66 49.28,17.58 49.28,15.55 49.66,15.16 51.82,15.16 64.9,28.25 64.9,29.26 71.12,35.48 71.12,37.77 66.42,42.47 60.32,42.47

## Text on the board
Top Silkscreen Layer: LeftLowGate | LeftHighGate | RightHighGate | RightLowGate
